# EasyEDA Pro project C108_STM32.eprj, schematic Schematic6
Board Name: WIFI; Create Date: 2025-01-08; Page Name: P1; Project Name: C108_STM32; Schematic Name: Schematic6; Update Date: 2025-01-09; Company: 嘉立创EDA; Page Size: A4; Version: V1.0
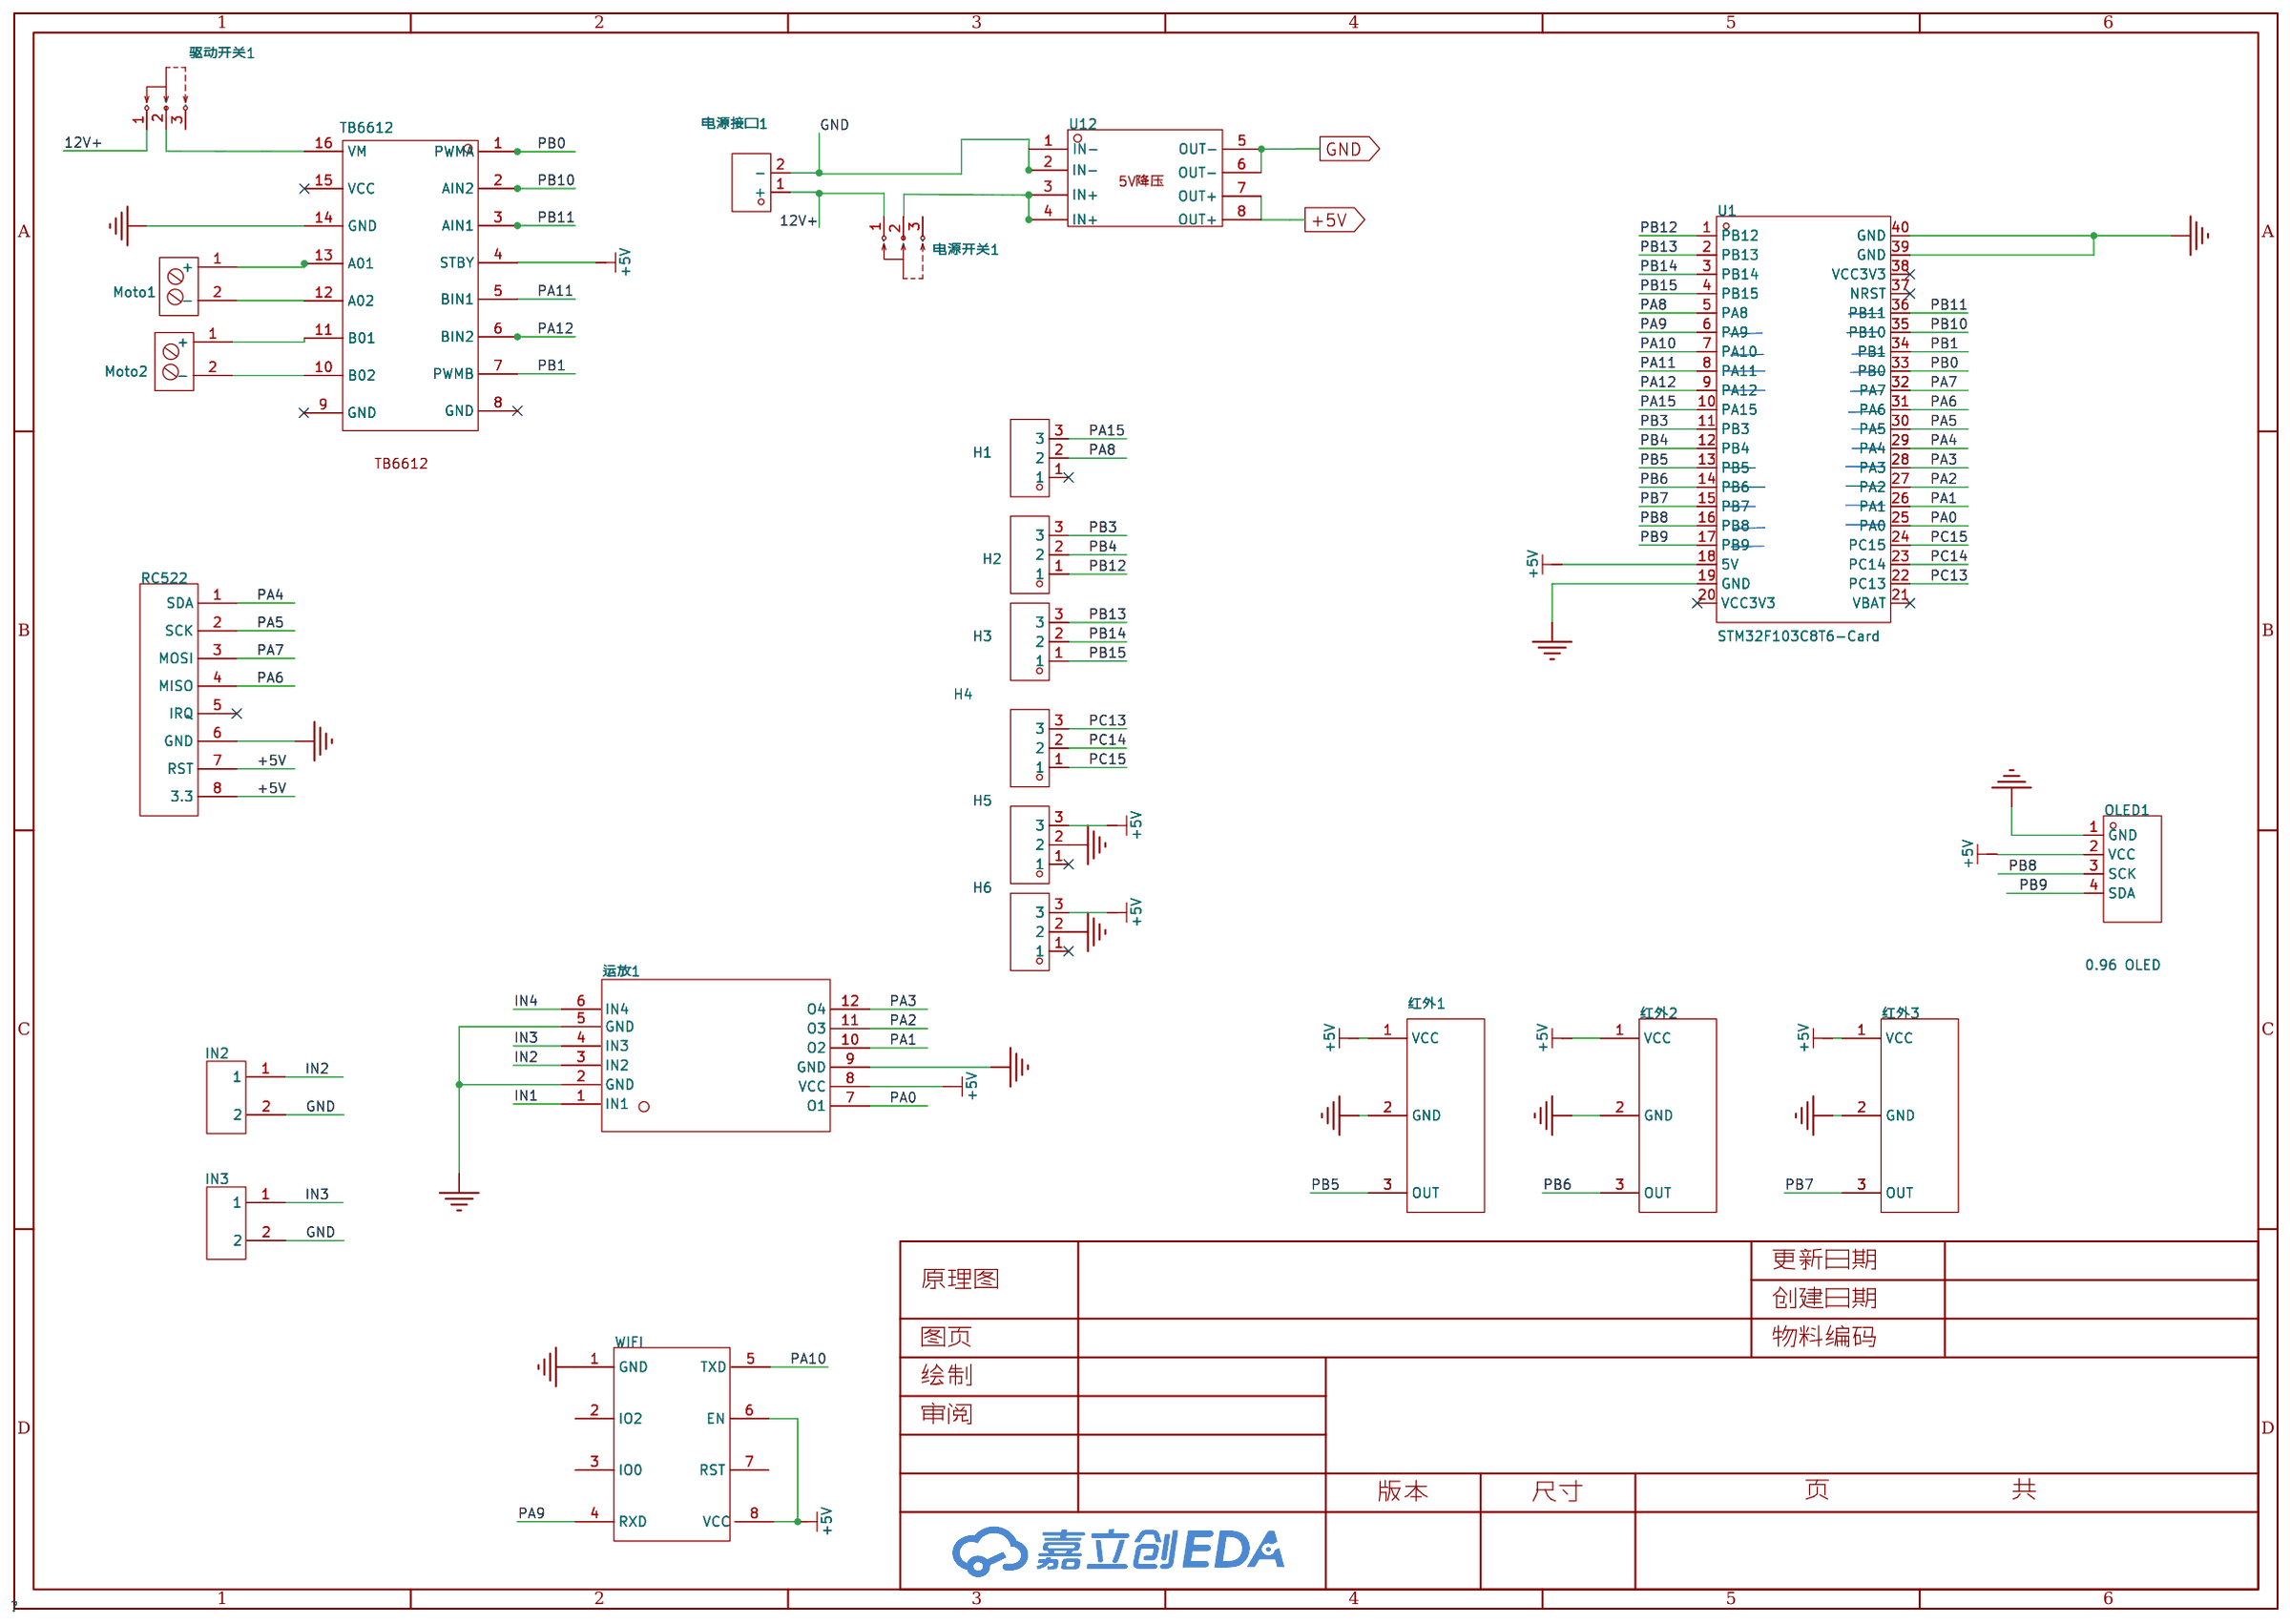
[diagram p5: schematic sheet]

## Parts
H1  -  [HDR-TH_3P-P2.54-V-F]
H2  -  [HDR-TH_3P-P2.54-V-F]
H3  -  [HDR-TH_3P-P2.54-V-F]
H4  -  [HDR-TH_3P-P2.54-V-F]
H5  -  [HDR-TH_3P-P2.54-V-F]
H6  -  [HDR-TH_3P-P2.54-V-F]
IN2  -  [dianganxie]
IN3  -  [dianganxie]
Moto1  -  [端子]
Moto2  -  [端子]
OLED1  0.96 OLED  [HDR-TH_4P-P2.54-V-M-1]
RC522  -  [RC522]
TB6612  -  [TB6612_Board]
U1  STM32F103C8T6-Card  [CONN-TH_L53.3-W22.9_STM32F103C8T6-CARD]
U12  -  [降压mini]
WIFI  -  [ESP-01]
电源开关1  电源开关  [SW-TH_SHOU-HAN_SS12D10G4]
电源接口1  XH2.54*2P_直插  [CONN-TH_2P-P2.50-XH2.54-2P]
红外1  -  [红外避障]
红外2  -  [红外避障]
红外3  -  [红外避障]
运放1  -  [逐飞运放]
驱动开关1  驱动开关  [SW-TH_SHOU-HAN_SS12D10G4]

## Library data of the parts
H1-H6 = HDR-F_2.54_1x3P: Supplier Part: C541850; Supplier Footprint: 插件
IN2 IN3 = dianganxie
Moto1 Moto2 = 端子
OLED1 = 2.54*4单排: Supplier Part: C9900016163; Supplier Footprint: 2.54x4; JLCPCB Part Class: 扩展库; Supplier: LCSC
RC522 = RC522
TB6612 = TB6612_Board
U1 = STM32F103C8T6-Card: Supplier Part: C9900077949; Supplier Footprint: 插件; Supplier: LCSC
U12 = 降压mini
WIFI = ESP-01
电源开关1 驱动开关1 = SS12D10开关: LCSC Part Name: SS12D10/G5/直角; Supplier Part: C9900029541; Supplier Footprint: THrough hole; JLCPCB Part Class: 扩展库; Supplier: LCSC
电源接口1 = XH2.54*2P_直插: Supplier Part: C9900008615; Supplier Footprint: XH2.54_2P; Supplier: LCSC
红外1-红外3 = 红外避障
运放1 = 逐飞运放

## Nets
12V+: 电源开关1.1 电源接口1.1(+) 驱动开关1.1
+5V: H5.3 H6.3 OLED1.2(VCC) RC522.7(RST) RC522.8(3.3) TB6612.4(STBY) U1.18(5V) U12.7(OUT+) U12.8(OUT+) WIFI.6(EN) WIFI.8(VCC) 红外1.1(VCC) 红外2.1(VCC) 红外3.1(VCC) 运放1.8(VCC)
GND: H5.2 H6.2 IN2.2 IN3.2 OLED1.1(GND) RC522.6(GND) TB6612.14(GND) U1.19(GND) U1.39(GND) U1.40(GND) U12.2(IN-) U12.6(OUT-) WIFI.1(GND) 电源接口1.2(-) 红外1.2(GND) 红外2.2(GND) 红外3.2(GND) 运放1.2(GND) 运放1.5(GND) 运放1.9(GND)
IN1: 运放1.1(IN1)
IN2: IN2.1 运放1.3(IN2)
IN3: IN3.1 运放1.4(IN3)
IN4: 运放1.6(IN4)
PA0: U1.25(PA0) 运放1.7(O1)
PA1: U1.26(PA1) 运放1.10(O2)
PA2: U1.27(PA2) 运放1.11(O3)
PA3: U1.28(PA3) 运放1.12(O4)
PA4: RC522.1(SDA) U1.29(PA4)
PA5: RC522.2(SCK) U1.30(PA5)
PA6: RC522.4(MISO) U1.31(PA6)
PA7: RC522.3(MOSI) U1.32(PA7)
PA8: H1.2 U1.5(PA8)
PA9: U1.6(PA9) WIFI.4(RXD)
PA10: U1.7(PA10) WIFI.5(TXD)
PA11: TB6612.5(BIN1) U1.8(PA11)
PA12: TB6612.6(BIN2) U1.9(PA12)
PA15: H1.3 U1.10(PA15)
PB0: TB6612.1(PWMA) U1.33(PB0)
PB1: TB6612.7(PWMB) U1.34(PB1)
PB3: H2.3 U1.11(PB3)
PB4: H2.2 U1.12(PB4)
PB5: U1.13(PB5) 红外1.3(OUT)
PB6: U1.14(PB6) 红外2.3(OUT)
PB7: U1.15(PB7) 红外3.3(OUT)
PB8: OLED1.3(SCK) U1.16(PB8)
PB9: OLED1.4(SDA) U1.17(PB9)
PB10: TB6612.2(AIN2) U1.35(PB10)
PB11: TB6612.3(AIN1) U1.36(PB11)
PB12: H2.1 U1.1(PB12)
PB13: H3.3 U1.2(PB13)
PB14: H3.2 U1.3(PB14)
PB15: H3.1 U1.4(PB15)
PC13: H4.3 U1.22(PC13)
PC14: H4.2 U1.23(PC14)
PC15: H4.1 U1.24(PC15)
$1N1038: Moto1.1(+) TB6612.13(A01)
$1N1040: Moto2.1(+) TB6612.11(B01)
$1N1041: Moto2.2(-) TB6612.10(B02)
$1N1057: TB6612.16(VM) 驱动开关1.2
Net-(U12-3): U12.3(IN+) U12.4(IN+)

Not connected (* = marked no-connect by the designer): H1 1*; H5 1*; H6 1*; Moto1 2(-); RC522 5(IRQ)*; TB6612 8(GND)* 9(GND)* 12(A02) 15(VCC)*; U1 20(VCC3V3)* 21(VBAT)* 37(NRST)* 38(VCC3V3)*; U12 1(IN-) 5(OUT-); WIFI 2(IO2) 3(IO0) 7(RST); 电源开关1 2 3; 驱动开关1 3
